# Altium schematic sheet Cpcis_connectors_P1_P2_P3.SchDoc
size 420 x 297 mm; DocumentNumber: 3; SheetNumber: 3; SheetTotal: 8; EDA_Number: ARTIQ; ModifiedBy: -; Title2: -; DivGrp: ISE; ModifiedDate: -
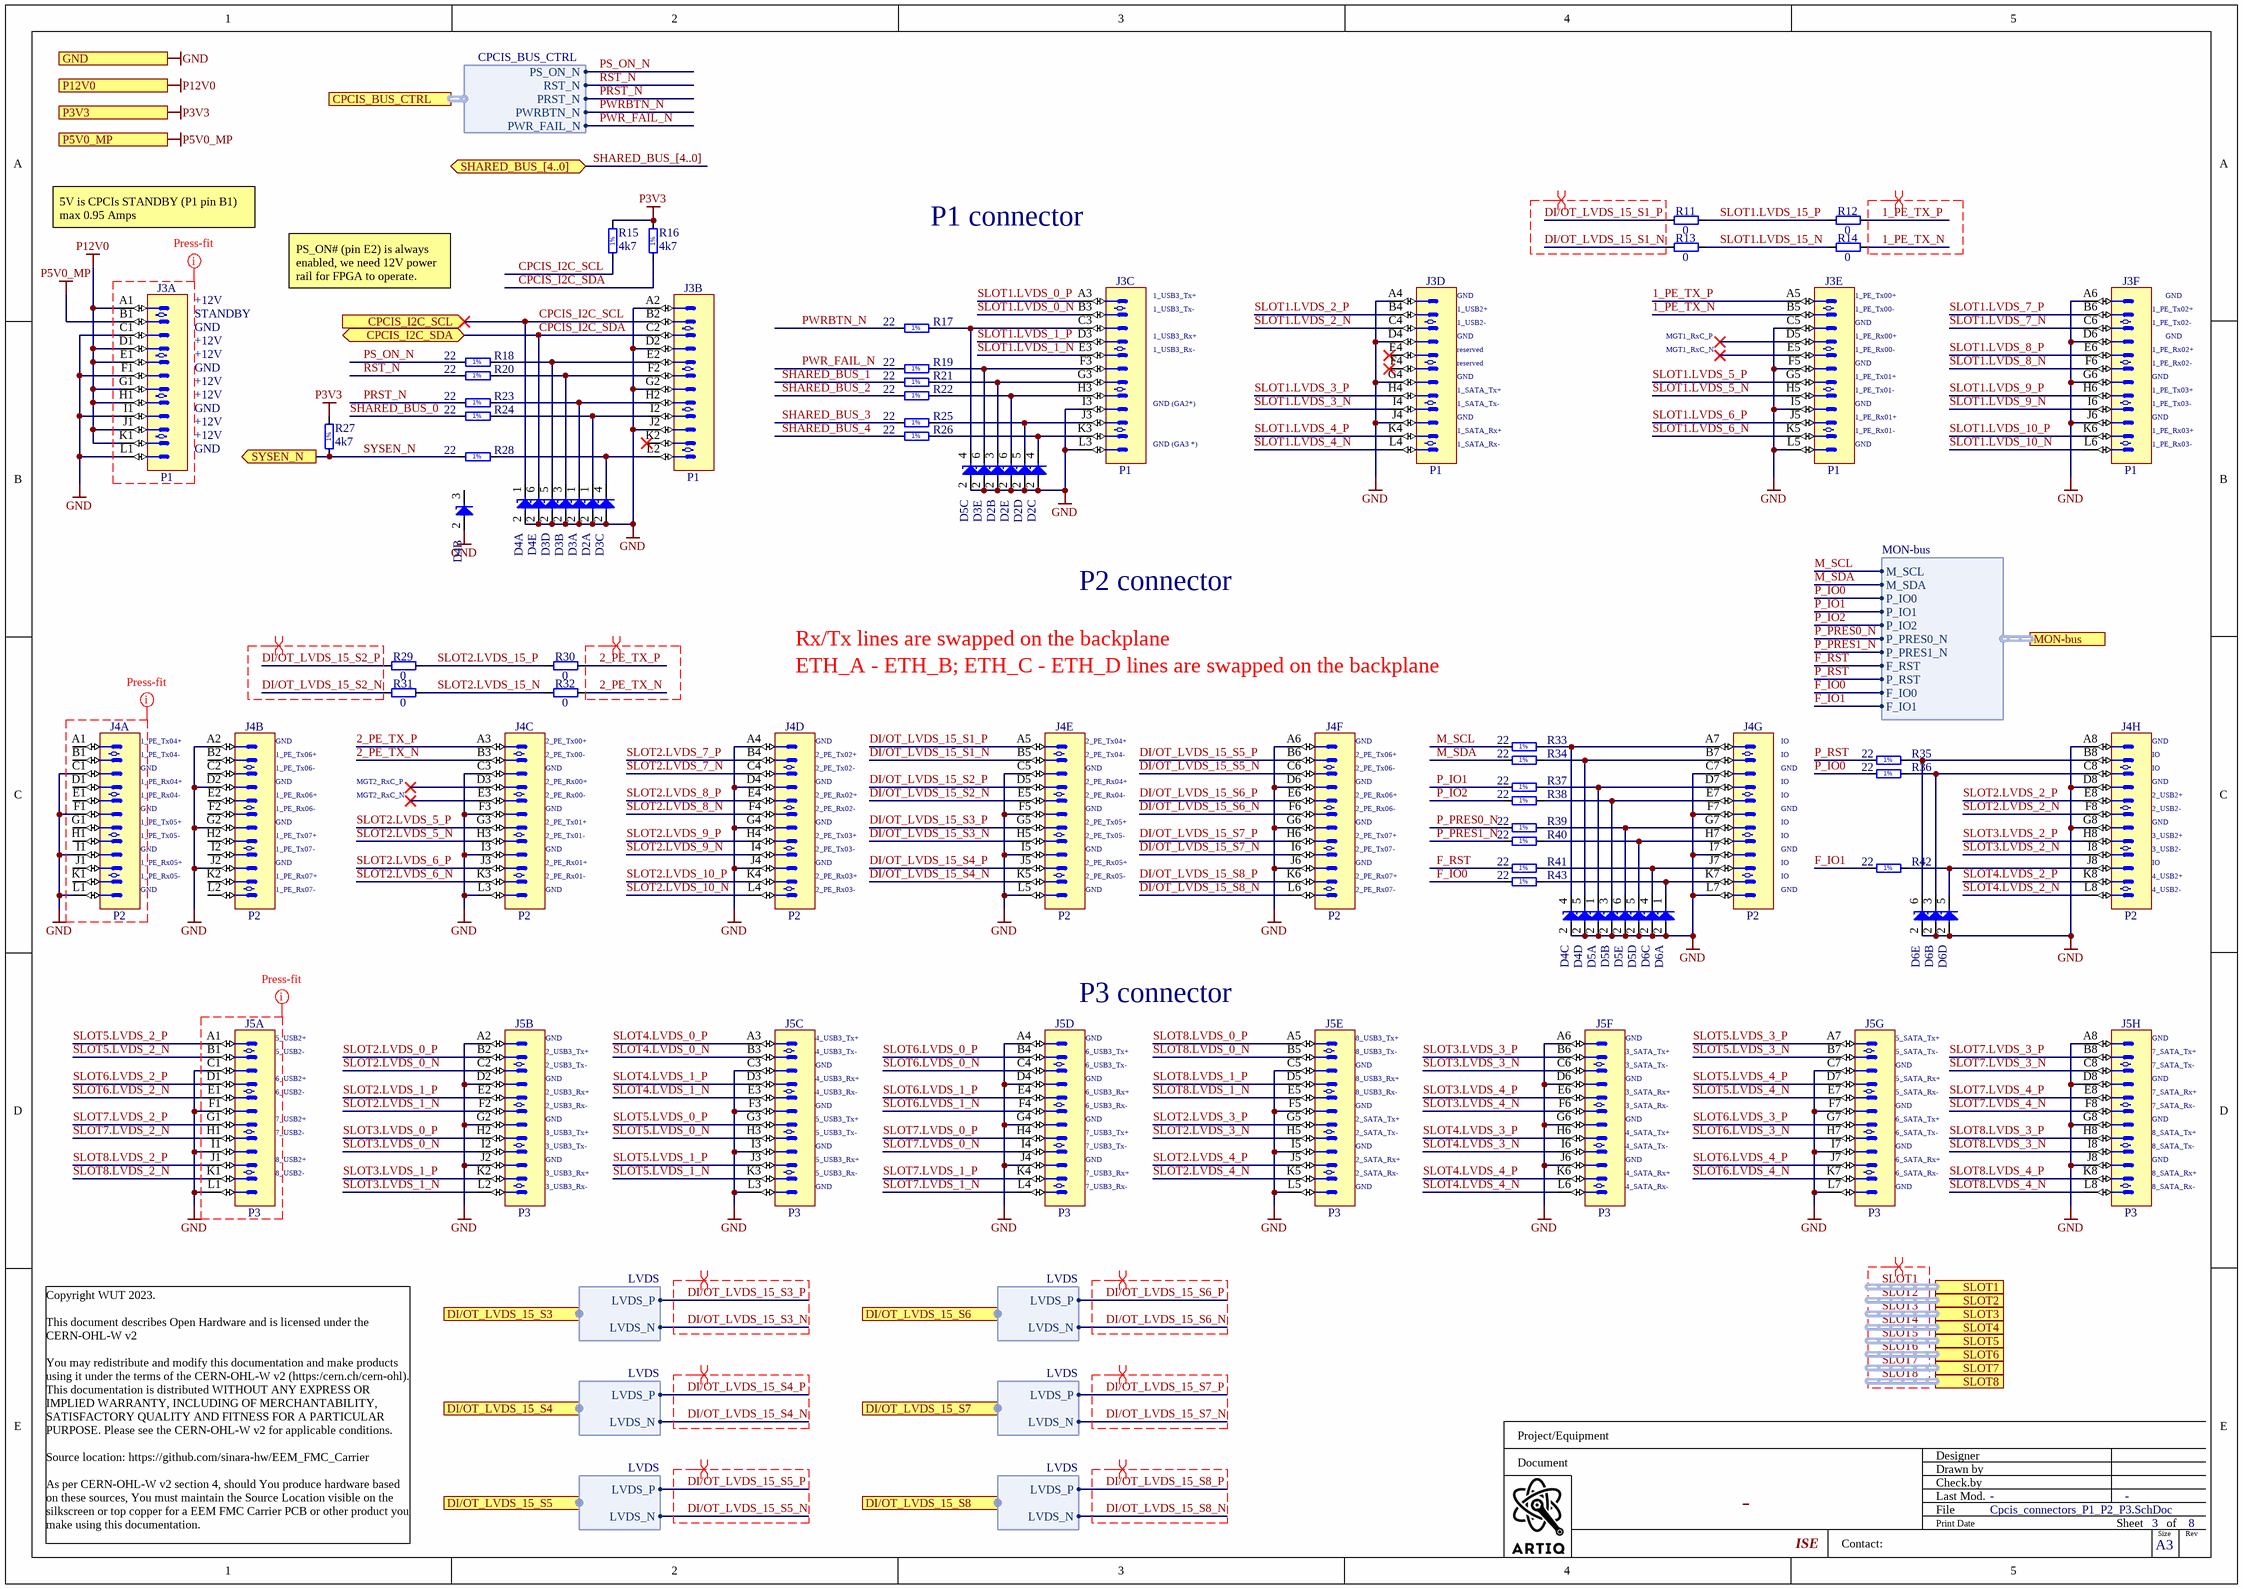
[diagram p0: Cpcis_connectors_P1_P2_P3.SchDoc]

## Parts
D2  PESD3V3L5UY  [SOT65P210X110-6N]  (value not drawn)  (parts A,B,C,D,E of 5)
D3  PESD3V3L5UY  [SOT65P210X110-6N]  (value not drawn)  (parts A,B,C,D,E of 5)
D4  PESD3V3L5UY  [SOT65P210X110-6N]  (value not drawn)  (parts A,B,C,D,E of 5)
D5  PESD3V3L5UY  [SOT65P210X110-6N]  (value not drawn)  (parts A,B,C,D,E of 5)
D6  PESD3V3L5UY  [SOT65P210X110-6N]  (value not drawn)  (parts A,B,C,D,E of 5)
J3  P1  [AMPHENOL_10052825-101LF]  (parts A,B,C,D,E,F of 6)
J4  P2  [AMPHENOL_10052837-101LF]  (parts A,B,C,D,E,F,G,H of 8)
J5  P3  [AMPHENOL_10052837-101LF]  (parts A,B,C,D,E,F,G,H of 8)
R11  0  [RESC0603X28N]
R12  0  [RESC0603X28N]
R13  0  [RESC0603X28N]
R14  0  [RESC0603X28N]
R15  4k7  [RESC1005X40N]
R16  4k7  [RESC1005X40N]
R17  22  [RESC1005X40N]
R18  22  [RESC1005X40N]
R19  22  [RESC1005X40N]
R20  22  [RESC1005X40N]
R21  22  [RESC1005X40N]
R22  22  [RESC1005X40N]
R23  22  [RESC1005X40N]
R24  22  [RESC1005X40N]
R25  22  [RESC1005X40N]
R26  22  [RESC1005X40N]
R27  4k7  [RESC1005X40N]
R28  22  [RESC1005X40N]
R29  0  [RESC0603X28N]
R30  0  [RESC0603X28N]
R31  0  [RESC0603X28N]
R32  0  [RESC0603X28N]
R33  22  [RESC1005X40N]
R34  22  [RESC1005X40N]
R35  22  [RESC1005X40N]
R36  22  [RESC1005X40N]
R37  22  [RESC1005X40N]
R38  22  [RESC1005X40N]
R39  22  [RESC1005X40N]
R40  22  [RESC1005X40N]
R41  22  [RESC1005X40N]
R42  22  [RESC1005X40N]
R43  22  [RESC1005X40N]

## Ports
CPCIS_BUS_CTRL (harness CPCIS_BUS_CTRL), CPCIS_I2C_SCL (in), CPCIS_I2C_SDA (bidir), DI/OT_LVDS_15_S3 (harness LVDS), DI/OT_LVDS_15_S4 (harness LVDS), DI/OT_LVDS_15_S5 (harness LVDS), DI/OT_LVDS_15_S6 (harness LVDS), DI/OT_LVDS_15_S7 (harness LVDS), DI/OT_LVDS_15_S8 (harness LVDS), GND, MON-bus (harness MON-bus), P3V3 (in), P5V0_MP (out), P12V0 (out), SHARED_BUS_[4..0] (bidir), SLOT1 (harness SLOT), SLOT2 (harness SLOT), SLOT3 (harness SLOT), SLOT4 (harness SLOT), SLOT5 (harness SLOT), SLOT6 (harness ExtensionConnector), SLOT7 (harness SLOT), SLOT8 (harness ExtensionConnector), SYSEN_N (out)

## Harnesses
LVDS: LVDS_P, LVDS_N
CPCIS_BUS_CTRL: PS_ON_N, RST_N, PRST_N, PWRBTN_N, PWR_FAIL_N
MON-bus: M_SCL, M_SDA, P_IO0, P_IO1, P_IO2, P_PRES0_N, P_PRES1_N, F_RST, P_RST, F_IO0, F_IO1

## Nets
GND: D2.2(A) D3.2(A) D4.2(A) D5.2(A) D6.2(A) J3.A2 J3.A4 J3.A6 J3.C1 J3.C5 J3.D2 J3.D4 J3.D6 J3.F1 J3.F5 J3.G2 J3.G4 J3.G6 J3.I1 J3.I3 J3.I5 J3.J2 J3.J4 J3.J6 J3.L1 J3.L3 J3.L5 J4.A2 J4.A4 J4.A6 J4.A8 J4.C1 J4.C3 J4.C5 J4.C7 J4.D2 J4.D4 J4.D6 J4.D8 J4.F1 J4.F3 J4.F5 J4.F7 J4.G2 J4.G4 J4.G6 J4.G8 J4.I1 J4.I3 J4.I5 J4.I7 J4.J2 J4.J4 J4.J6 J4.L1 J4.L3 J4.L5 J4.L7 J5.A2 J5.A4 J5.A6 J5.A8 J5.C1 J5.C3 J5.C5 J5.C7 J5.D2 J5.D4 J5.D6 J5.D8 J5.F1 J5.F3 J5.F5 J5.F7 J5.G2 J5.G4 J5.G6 J5.G8 J5.I1 J5.I3 J5.I5 J5.I7 J5.J2 J5.J4 J5.J6 J5.J8 J5.L1 J5.L3 J5.L5 J5.L7 ; port GND
P3V3: R15.2 R16.2 R27.2 ; port P3V3
P5V0_MP: J3.B1 ; port P5V0_MP
P12V0: J3.A1 J3.D1 J3.E1 J3.G1 J3.H1 J3.J1 J3.K1 ; port P12V0
1_PE_TX_N: J3.B5 R14.2
1_PE_TX_P: J3.A5 R12.2
2_PE_TX_N: J4.B3 R32.2
2_PE_TX_P: J4.A3 R30.2
CPCIS_I2C_SCL: D4.1(C) J3.B2 R15.1 ; port CPCIS_I2C_SCL
CPCIS_I2C_SDA: D4.6(C) J3.C2 R16.1 ; port CPCIS_I2C_SDA
DI/OT_LVDS_15_S1_N: J4.B5 R13.1
DI/OT_LVDS_15_S1_P: J4.A5 R11.1
DI/OT_LVDS_15_S2_N: J4.E5 R31.1
DI/OT_LVDS_15_S2_P: J4.D5 R29.1
DI/OT_LVDS_15_S3_N: J4.H5 ; port DI/OT_LVDS_15_S3.LVDS_N
DI/OT_LVDS_15_S3_P: J4.G5 ; port DI/OT_LVDS_15_S3.LVDS_P
DI/OT_LVDS_15_S4_N: J4.K5 ; port DI/OT_LVDS_15_S4.LVDS_N
DI/OT_LVDS_15_S4_P: J4.J5 ; port DI/OT_LVDS_15_S4.LVDS_P
DI/OT_LVDS_15_S5_N: J4.C6 ; port DI/OT_LVDS_15_S5.LVDS_N
DI/OT_LVDS_15_S5_P: J4.B6 ; port DI/OT_LVDS_15_S5.LVDS_P
DI/OT_LVDS_15_S6_N: J4.F6 ; port DI/OT_LVDS_15_S6.LVDS_N
DI/OT_LVDS_15_S6_P: J4.E6 ; port DI/OT_LVDS_15_S6.LVDS_P
DI/OT_LVDS_15_S7_N: J4.I6 ; port DI/OT_LVDS_15_S7.LVDS_N
DI/OT_LVDS_15_S7_P: J4.H6 ; port DI/OT_LVDS_15_S7.LVDS_P
DI/OT_LVDS_15_S8_N: J4.L6 ; port DI/OT_LVDS_15_S8.LVDS_N
DI/OT_LVDS_15_S8_P: J4.K6 ; port DI/OT_LVDS_15_S8.LVDS_P
F_IO0: R43.1 ; port MON-bus.F_IO0
F_IO1: R42.1 ; port MON-bus.F_IO1
F_RST: R41.1 ; port MON-bus.F_RST
M_SCL: R33.1 ; port MON-bus.M_SCL
M_SDA: R34.1 ; port MON-bus.M_SDA
P_IO0: R36.1 ; port MON-bus.P_IO0
P_IO1: R37.1 ; port MON-bus.P_IO1
P_IO2: R38.1 ; port MON-bus.P_IO2
P_PRES0_N: R39.1 ; port MON-bus.P_PRES0_N
P_PRES1_N: R40.1 ; port MON-bus.P_PRES1_N
P_RST: R35.1 ; port MON-bus.P_RST
PRST_N: R23.1 ; port CPCIS_BUS_CTRL.PRST_N
PS_ON_N: R18.1 ; port CPCIS_BUS_CTRL.PS_ON_N
PWR_FAIL_N: R19.1 ; port CPCIS_BUS_CTRL.PWR_FAIL_N
PWRBTN_N: R17.1 ; port CPCIS_BUS_CTRL.PWRBTN_N
RST_N: R20.1 ; port CPCIS_BUS_CTRL.RST_N
SHARED_BUS_0: R24.1
SHARED_BUS_1: R21.1
SHARED_BUS_2: R22.1
SHARED_BUS_3: R25.1
SHARED_BUS_4: R26.1
SLOT1.LVDS_0_N: J3.B3
SLOT1.LVDS_0_P: J3.A3
SLOT1.LVDS_1_N: J3.E3
SLOT1.LVDS_1_P: J3.D3
SLOT1.LVDS_2_N: J3.C4
SLOT1.LVDS_2_P: J3.B4
SLOT1.LVDS_3_N: J3.I4
SLOT1.LVDS_3_P: J3.H4
SLOT1.LVDS_4_N: J3.L4
SLOT1.LVDS_4_P: J3.K4
SLOT1.LVDS_5_N: J3.H5
SLOT1.LVDS_5_P: J3.G5
SLOT1.LVDS_6_N: J3.K5
SLOT1.LVDS_6_P: J3.J5
SLOT1.LVDS_7_N: J3.C6
SLOT1.LVDS_7_P: J3.B6
SLOT1.LVDS_8_N: J3.F6
SLOT1.LVDS_8_P: J3.E6
SLOT1.LVDS_9_N: J3.I6
SLOT1.LVDS_9_P: J3.H6
SLOT1.LVDS_10_N: J3.L6
SLOT1.LVDS_10_P: J3.K6
SLOT1.LVDS_15_N: R13.2 R14.1
SLOT1.LVDS_15_P: R11.2 R12.1
SLOT2.LVDS_0_N: J5.C2
SLOT2.LVDS_0_P: J5.B2
SLOT2.LVDS_1_N: J5.F2
SLOT2.LVDS_1_P: J5.E2
SLOT2.LVDS_2_N: J4.F8
SLOT2.LVDS_2_P: J4.E8
SLOT2.LVDS_3_N: J5.H5
SLOT2.LVDS_3_P: J5.G5
SLOT2.LVDS_4_N: J5.K5
SLOT2.LVDS_4_P: J5.J5
SLOT2.LVDS_5_N: J4.H3
SLOT2.LVDS_5_P: J4.G3
SLOT2.LVDS_6_N: J4.K3
SLOT2.LVDS_6_P: J4.J3
SLOT2.LVDS_7_N: J4.C4
SLOT2.LVDS_7_P: J4.B4
SLOT2.LVDS_8_N: J4.F4
SLOT2.LVDS_8_P: J4.E4
SLOT2.LVDS_9_N: J4.I4
SLOT2.LVDS_9_P: J4.H4
SLOT2.LVDS_10_N: J4.L4
SLOT2.LVDS_10_P: J4.K4
SLOT2.LVDS_15_N: R31.2 R32.1
SLOT2.LVDS_15_P: R29.2 R30.1
SLOT3.LVDS_0_N: J5.I2
SLOT3.LVDS_0_P: J5.H2
SLOT3.LVDS_1_N: J5.L2
SLOT3.LVDS_1_P: J5.K2
SLOT3.LVDS_2_N: J4.I8
SLOT3.LVDS_2_P: J4.H8
SLOT3.LVDS_3_N: J5.C6
SLOT3.LVDS_3_P: J5.B6
SLOT3.LVDS_4_N: J5.F6
SLOT3.LVDS_4_P: J5.E6
SLOT4.LVDS_0_N: J5.B3
SLOT4.LVDS_0_P: J5.A3
SLOT4.LVDS_1_N: J5.E3
SLOT4.LVDS_1_P: J5.D3
SLOT4.LVDS_2_N: J4.L8
SLOT4.LVDS_2_P: J4.K8
SLOT4.LVDS_3_N: J5.I6
SLOT4.LVDS_3_P: J5.H6
SLOT4.LVDS_4_N: J5.L6
SLOT4.LVDS_4_P: J5.K6
SLOT5.LVDS_0_N: J5.H3
SLOT5.LVDS_0_P: J5.G3
SLOT5.LVDS_1_N: J5.K3
SLOT5.LVDS_1_P: J5.J3
SLOT5.LVDS_2_N: J5.B1
SLOT5.LVDS_2_P: J5.A1
SLOT5.LVDS_3_N: J5.B7
SLOT5.LVDS_3_P: J5.A7
SLOT5.LVDS_4_N: J5.E7
SLOT5.LVDS_4_P: J5.D7
SLOT6.LVDS_0_N: J5.C4
SLOT6.LVDS_0_P: J5.B4
SLOT6.LVDS_1_N: J5.F4
SLOT6.LVDS_1_P: J5.E4
SLOT6.LVDS_2_N: J5.E1
SLOT6.LVDS_2_P: J5.D1
SLOT6.LVDS_3_N: J5.H7
SLOT6.LVDS_3_P: J5.G7
SLOT6.LVDS_4_N: J5.K7
SLOT6.LVDS_4_P: J5.J7
SLOT7.LVDS_0_N: J5.I4
SLOT7.LVDS_0_P: J5.H4
SLOT7.LVDS_1_N: J5.L4
SLOT7.LVDS_1_P: J5.K4
SLOT7.LVDS_2_N: J5.H1
SLOT7.LVDS_2_P: J5.G1
SLOT7.LVDS_3_N: J5.C8
SLOT7.LVDS_3_P: J5.B8
SLOT7.LVDS_4_N: J5.F8
SLOT7.LVDS_4_P: J5.E8
SLOT8.LVDS_0_N: J5.B5
SLOT8.LVDS_0_P: J5.A5
SLOT8.LVDS_1_N: J5.E5
SLOT8.LVDS_1_P: J5.D5
SLOT8.LVDS_2_N: J5.K1
SLOT8.LVDS_2_P: J5.J1
SLOT8.LVDS_3_N: J5.I8
SLOT8.LVDS_3_P: J5.H8
SLOT8.LVDS_4_N: J5.L8
SLOT8.LVDS_4_P: J5.K8
SYSEN_N: R27.1 R28.1 ; port SYSEN_N
NetD2_1: D2.1(C) J3.I2 R24.2
NetD2_3: D2.3(C) J3.G3 R21.2
NetD2_4: D2.4(C) J3.K3 R26.2
NetD2_5: D2.5(C) J3.J3 R25.2
NetD2_6: D2.6(C) J3.H3 R22.2
NetD3_1: D3.1(C) J3.H2 R23.2
NetD3_3: D3.3(C) J3.F2 R20.2
NetD3_4: D3.4(C) J3.L2 R28.2
NetD3_5: D3.5(C) J3.E2 R18.2
NetD3_6: D3.6(C) J3.F3 R19.2
NetD4_4: D4.4(C) J4.A7 R33.2
NetD4_5: D4.5(C) J4.B7 R34.2
NetD5_1: D5.1(C) J4.D7 R37.2
NetD5_3: D5.3(C) J4.E7 R38.2
NetD5_4: D5.4(C) J3.C3 R17.2
NetD5_5: D5.5(C) J4.H7 R40.2
NetD5_6: D5.6(C) J4.G7 R39.2
NetD6_1: D6.1(C) J4.K7 R43.2
NetD6_3: D6.3(C) J4.C8 R36.2
NetD6_4: D6.4(C) J4.J7 R41.2
NetD6_5: D6.5(C) J4.J8 R42.2
NetD6_6: D6.6(C) J4.B8 R35.2

Not connected (* = marked no-connect by the designer): D4 3(C); J3 D5* E4* E5* F4* K2*; J4 A1 B1 B2 C2 D1 D3* E1 E2 E3* F2 G1 H1 H2 I2 J1 K1 K2 L2

## Buses and harness runs
bus SHARED_BUS_[4..0] = port SHARED_BUS_[4..0]
harness SLOT1 = port SLOT1
harness SLOT2 = port SLOT2
harness SLOT3 = port SLOT3
harness SLOT4 = port SLOT4
harness SLOT5 = port SLOT5
harness SLOT6 = port SLOT6
harness SLOT7 = port SLOT7
harness SLOT8 = port SLOT8

## Layout directives
differential pair: 1_PE_TX_N, 1_PE_TX_P, 2_PE_TX_N, 2_PE_TX_P, DI/OT_LVDS_15_S1_N, DI/OT_LVDS_15_S1_P, DI/OT_LVDS_15_S2_N, DI/OT_LVDS_15_S2_P, DI/OT_LVDS_15_S3_N, DI/OT_LVDS_15_S3_P, DI/OT_LVDS_15_S4_N, DI/OT_LVDS_15_S4_P, DI/OT_LVDS_15_S5_N, DI/OT_LVDS_15_S5_P, DI/OT_LVDS_15_S6_N, DI/OT_LVDS_15_S6_P, DI/OT_LVDS_15_S7_N, DI/OT_LVDS_15_S7_P, DI/OT_LVDS_15_S8_N, DI/OT_LVDS_15_S8_P, SLOT1, SLOT2, SLOT3, SLOT4, SLOT5, SLOT6, SLOT7, SLOT8
CompClassName: Press-fit: (no net found under the mark)

## Notes on the sheet
- 5V is CPCIs STANDBY (P1 pin B1)
  max 0.95 Amps
- P1 connector
- (near J3) +12V
- (near J3) STANDBY
- PS_ON# (pin E2) is always enabled, we need 12V power rail for FPGA to operate.
- (near J3) 1_USB3_Tx+
- (near J3) 1_USB3_Tx-
- (near J3) 1_USB2+
- (near J3) 1_USB2-
- (near J3) GND
- 1_PE_Tx00+
- 1_PE_Tx00-
- (near J3) 1_PE_Tx02+
- (near J3) 1_PE_Tx02-
- GND
- (near J3) 1_USB3_Rx+
- (near J3) 1_USB3_Rx-
- (near J3) 1_SATA_Tx+
- (near J3) reserved
- MGT1_RxC_P
- MGT1_RxC_N
- (near J3) 1_PE_Tx01+
- (near J3) 1_PE_Tx01-
- (near J3) 1_PE_Rx00+
- (near J3) 1_PE_Rx00-
- (near J3) 1_PE_Rx02+
- (near J3) 1_PE_Rx02-
- (near J3) 1_PE_Tx03+
- (near J3) GND (GA2*)
- (near J3) GND (GA3 *)
- (near J3) 1_SATA_Tx-
- (near J3) 1_SATA_Rx+
- (near J3) 1_SATA_Rx-
- (near J3) 1_PE_Rx01+
- (near J3) 1_PE_Rx01-
- (near J3) 1_PE_Tx03-
- (near J3) 1_PE_Rx03+
- (near J3) 1_PE_Rx03-
- P2 connector
- Rx/Tx lines are swapped on the backplane
- ETH_A - ETH_B; ETH_C - ETH_D lines are swapped on the backplane
- (near J4) 1_PE_Tx04+
- (near J4) 1_PE_Tx04-
- (near J4) GND
- (near J4) 1_PE_Rx04+
- (near J4) 1_PE_Rx04-
- (near J4) 1_PE_Tx06+
- (near J4) 1_PE_Tx06-
- (near J4) 1_PE_Rx06+
- MGT2_RxC_P
- MGT2_RxC_N
- 2_PE_Tx00+
- 2_PE_Tx00-
- (near J4) 2_PE_Rx00+
- (near J4) 2_PE_Rx00-
- (near J4) 2_PE_Tx02+
- (near J4) 2_PE_Tx02-
- (near J4) 2_PE_Rx02+
- (near J4) 2_PE_Tx04+
- (near J4) 2_PE_Tx04-
- (near J4) 2_PE_Rx04+
- (near J4) 2_PE_Rx04-
- (near J4) 2_PE_Tx06+
- (near J4) 2_PE_Tx06-
- (near J4) 2_PE_Rx06+
- (near J4) IO
- (near J4) 2_USB2+
- (near J4) 1_PE_Tx05+
- (near J4) 1_PE_Tx05-
- (near J4) 1_PE_Rx05+
- (near J4) 1_PE_Rx06-
- (near J4) 1_PE_Tx07+
- (near J4) 1_PE_Tx07-
- (near J4) 2_PE_Tx01+
- (near J4) 2_PE_Tx01-
- (near J4) 2_PE_Rx01+
- (near J4) 2_PE_Rx02-
- (near J4) 2_PE_Tx03+
- (near J4) 2_PE_Tx03-
- (near J4) 2_PE_Tx05+
- (near J4) 2_PE_Tx05-
- (near J4) 2_PE_Rx05+
- (near J4) 2_PE_Rx06-
- (near J4) 2_PE_Tx07+
- (near J4) 2_PE_Tx07-
- (near J4) 2_USB2-
- (near J4) 3_USB2+
- (near J4) 3_USB2-
- (near J4) 1_PE_Rx05-
- (near J4) 1_PE_Rx07+
- (near J4) 1_PE_Rx07-
- (near J4) 2_PE_Rx01-
- (near J4) 2_PE_Rx03+
- (near J4) 2_PE_Rx03-
- (near J4) 2_PE_Rx05-
- (near J4) 2_PE_Rx07+
- (near J4) 2_PE_Rx07-
- (near J4) 4_USB2+
- (near J4) 4_USB2-
- (near J5) 5_USB2+
- (near J5) 5_USB2-
- (near J5) GND
- (near J5) 2_USB3_Tx+
- (near J5) 2_USB3_Tx-
- (near J5) 4_USB3_Tx+
- (near J5) 4_USB3_Tx-
- (near J5) P3 connector
- (near J5) 6_USB3_Tx+
- (near J5) 6_USB3_Tx-
- (near J5) 8_USB3_Tx+
- (near J5) 8_USB3_Tx-
- (near J5) 3_SATA_Tx+
- (near J5) 3_SATA_Tx-
- (near J5) 5_SATA_Tx+
- (near J5) 5_SATA_Tx-
- (near J5) 7_SATA_Tx+
- (near J5) 7_SATA_Tx-
- (near J5) 6_USB2+
- (near J5) 6_USB2-
- (near J5) 7_USB2+
- (near J5) 7_USB2-
- (near J5) 2_USB3_Rx+
- (near J5) 2_USB3_Rx-
- (near J5) 3_USB3_Tx+
- (near J5) 4_USB3_Rx+
- (near J5) 4_USB3_Rx-
- (near J5) 5_USB3_Tx+
- (near J5) 5_USB3_Tx-
- (near J5) 6_USB3_Rx+
- (near J5) 6_USB3_Rx-
- (near J5) 7_USB3_Tx+
- (near J5) 8_USB3_Rx+
- (near J5) 8_USB3_Rx-
- (near J5) 2_SATA_Tx+
- (near J5) 2_SATA_Tx-
- (near J5) 3_SATA_Rx+
- (near J5) 3_SATA_Rx-
- (near J5) 4_SATA_Tx+
- (near J5) 5_SATA_Rx+
- (near J5) 5_SATA_Rx-
- (near J5) 6_SATA_Tx+
- (near J5) 6_SATA_Tx-
- (near J5) 7_SATA_Rx+
- (near J5) 7_SATA_Rx-
- (near J5) 8_SATA_Tx+
- (near J5) 8_USB2+
- (near J5) 8_USB2-
- (near J5) 3_USB3_Tx-
- (near J5) 3_USB3_Rx+
- (near J5) 3_USB3_Rx-
- (near J5) 5_USB3_Rx+
- (near J5) 5_USB3_Rx-
- (near J5) 7_USB3_Tx-
- (near J5) 7_USB3_Rx+
- (near J5) 7_USB3_Rx-
- (near J5) 2_SATA_Rx+
- (near J5) 2_SATA_Rx-
- (near J5) 4_SATA_Tx-
- (near J5) 4_SATA_Rx+
- (near J5) 4_SATA_Rx-
- (near J5) 6_SATA_Rx+
- (near J5) 6_SATA_Rx-
- (near J5) 8_SATA_Tx-
- (near J5) 8_SATA_Rx+
- (near J5) 8_SATA_Rx-
- Project/Equipment
- Document
- Designer
- Drawn by
- Check.by
- Copyright WUT 2023.
  This document describes Open Hardware and is licensed under the CERN-OHL-W v2
  You may redistribute and modify this documentation and make products using it under the terms of the CERN-OHL-W v2 (https:/cern.ch/cern-ohl). This documentation is distributed WITHOUT ANY EXPRESS OR IMPLIED WARRANTY, INCLUDING OF MERCHANTABILITY, SATISFACTORY QUALITY AND FITNESS FOR A PARTICULAR PURPOSE. Please see the CERN-OHL-W v2 for applicable conditions.
  Source location: https://github.com/sinara-hw/EEM_FMC_Carrier
  As per CERN-OHL-W v2 section 4, should You produce hardware based on these sources, You must maintain the Source Location visible on the silkscreen or top copper for a EEM FMC Carrier PCB or other product you make using this documentation.
- Contact:
- File
- Last Mod.
- Print Date
- Sheet
- Size
- A3
- of
- Rev
- (in symbol R0402_4K7_1%_0.0625W_100PPM) 1%
- (in symbol R0402_22R_1%_0.0625W_100PPM) 1%

## Library data of the parts
D2-D6 = PESD3V3L5UY: Fivefold ESD Protection Diode Arrays; Part Description: Fivefold ESD Protection Diode Arrays (30kV); Manufacturer: NEXPERIA; Voltage: 3.3V; Power: 200W; PressFit: No; Bonding: No; Part Number: PESD3V3L5UY; Component Kind: Standard; Component Type: Standard; Device: PESD3V3L5UY; PackageDescription: SOT363, SC-88, 0.65mm Pitch; 6 Pin, 1.25mm W X 2.00mm L X 1.10mm H body, IPC Medium Density; Manufacturer Part Number: PESD3V3L5UY; Pin Count: 6; Case: SOT363; Mounted: Yes; Socket: No; SMD: Yes; Sense: No; ComponentHeight: 1.1mm; HelpURL: \\cern.ch\dfs\Applications\Altium\Datasheets\PESD3V3L5UY.pdf; Author: CERN DEM WB; CreateDate: 05.07.2021; LatestRevisionDate: 05.07.2021
J3 = AMPHENOL_10052825-101LF: 72 Contacts Header, 6 Columns, 4 Pairs per Column; Part Description: 72 Contacts, 2mm Pitch, 6 Columns, 4 Pairs per Column, 4 Walls, Right Angle Header; Part Number: AMPHENOL_10052825-101LF; Component Kind: Standard; Component Type: Standard; Pin Count: 72; Family: AirMax VS; Mounted: Yes; Socket: No; SMD: No; PressFit: Yes; Sense: No; Status: None; Manufacturer: AMPHENOL; Manufacturer Part Number: 10052825-101LF; ComponentHeight: 15.35mm; HelpURL: \\cern.ch\dfs\Applications\Altium\Datasheets\AMPHENOL_10052825-101LF.pdf; ComponentLink1URL: \\cern.ch\dfs\Applications\Altium\Datasheets\AMPHENOL_10052825-101LF_Application.pdf; ComponentLink1Description: Application; Author: CERN DEM MR; CreateDate: 19/02/2018; LatestRevisionDate: 19/02/2018; Classname: Overlapping
J4 J5 = AMPHENOL_10052837-101LF: 96 Contacts Header, 8 Columns, 4 Pairs per Column; Part Description: 96 Contacts, 2mm Pitch, 8 Columns, 4 Pairs per Column, 2 Walls, Right Angle Header; Part Number: AMPHENOL_10052837-101LF; Component Kind: Standard; Component Type: Standard; Pin Count: 96; Family: AirMax VS; Mounted: Yes; Socket: No; SMD: No; PressFit: Yes; Sense: No; Status: None; Manufacturer: AMPHENOL; Manufacturer Part Number: 10052837-101LF; ComponentHeight: 15.35mm; HelpURL: \\cern.ch\dfs\Applications\Altium\Datasheets\AMPHENOL_10052837-101LF.pdf; ComponentLink1URL: \\cern.ch\dfs\Applications\Altium\Datasheets\AMPHENOL_10052837-101LF_Application.pdf; ComponentLink1Description: Application; Author: CERN DEM MR; CreateDate: 19/02/2018; LatestRevisionDate: 19/02/2018
R11-R14 R29-R32 = R0201_0R_JUMPER: Resistor; Part Description: 1A (0.05R Max DC Resistance) Zero Ohm Jumper; Manufacturer: GENERIC; Manufacturer1 Part Number: CRCW02010000Z0ED; PressFit: No; Part Number: R0201_0R_JUMPER; Component Kind: Standard; Component Type: Standard; Pin Count: 2; Value: 0; Status: Not Recommended; Manufacturer Part Number: R0201_0R_JUMPER; Case: 0201; Mounted: Yes; Sense: No; Socket: No; SMD: Yes; Manufacturer1 Example: VISHAY; Manufacturer1 ComponentHeight: 0.27mm; HelpURL: \\cern.ch\dfs\Applications\Altium\Datasheets\R0201_VISHAY_CRCW e3.pdf; Author: CERN DEM JLC; CreateDate: 19.11.2014; LatestRevisionDate: 08.01.2015
R15 R16 R27 = R0402_4K7_1%_0.0625W_100PPM: Resistor - 1%; Part Description: General Purpose Thick Film Chip Resistor; Manufacturer: GENERIC; Manufacturer1 Part Number: 232270674702L; TC: ±100ppm/°C; PressFit: No; Part Number: R0402_4K7_1%_0.0625W_100PPM; Component Kind: Standard; Component Type: Standard; Pin Count: 2; Value: 4k7; Status: Not Recommended; Power: 0.0625W; Tolerance: ±1%; Manufacturer Part Number: R0402_4K7_1%_0.0625W_100PPM; Case: 0402; Mounted: Yes; Sense: No; Socket: No; SMD: Yes; Manufacturer1 Example: YAGEO PHYCOMP; Manufacturer1 ComponentHeight: 0.4mm; HelpURL: \\cern.ch\dfs\Applications\Altium\Datasheets\R0402_Phycomp_RC0402.pdf; Author: CERN DEM JLC; CreateDate: 03-Dec-07; LatestRevisionDate: 17-Oct-12
R17-R26 R28 R33-R43 = R0402_22R_1%_0.0625W_100PPM: Resistor - 1%; Part Description: General Purpose Thick Film Chip Resistor; Manufacturer: GENERIC; Manufacturer1 Part Number: 232270672209L; TC: ±100ppm/°C; PressFit: No; Part Number: R0402_22R_1%_0.0625W_100PPM; Component Kind: Standard; Component Type: Standard; Pin Count: 2; Value: 22; Status: Not Recommended; Power: 0.0625W; Tolerance: ±1%; Manufacturer Part Number: R0402_22R_1%_0.0625W_100PPM; Case: 0402; Mounted: Yes; Socket: No; SMD: Yes; Manufacturer1 Example: YAGEO PHYCOMP; Manufacturer1 ComponentHeight: 0.4mm; HelpURL: \\cern.ch\dfs\Applications\Altium\Datasheets\R0402_Phycomp_RC0402.pdf; Author: CERN DEM JLC; CreateDate: 03.12.2007; LatestRevisionDate: 17.10.2012; Sense: No